# EasyEDA Pro project E33_Panel_2023.9.26.eprj, board PCB1 (continued)
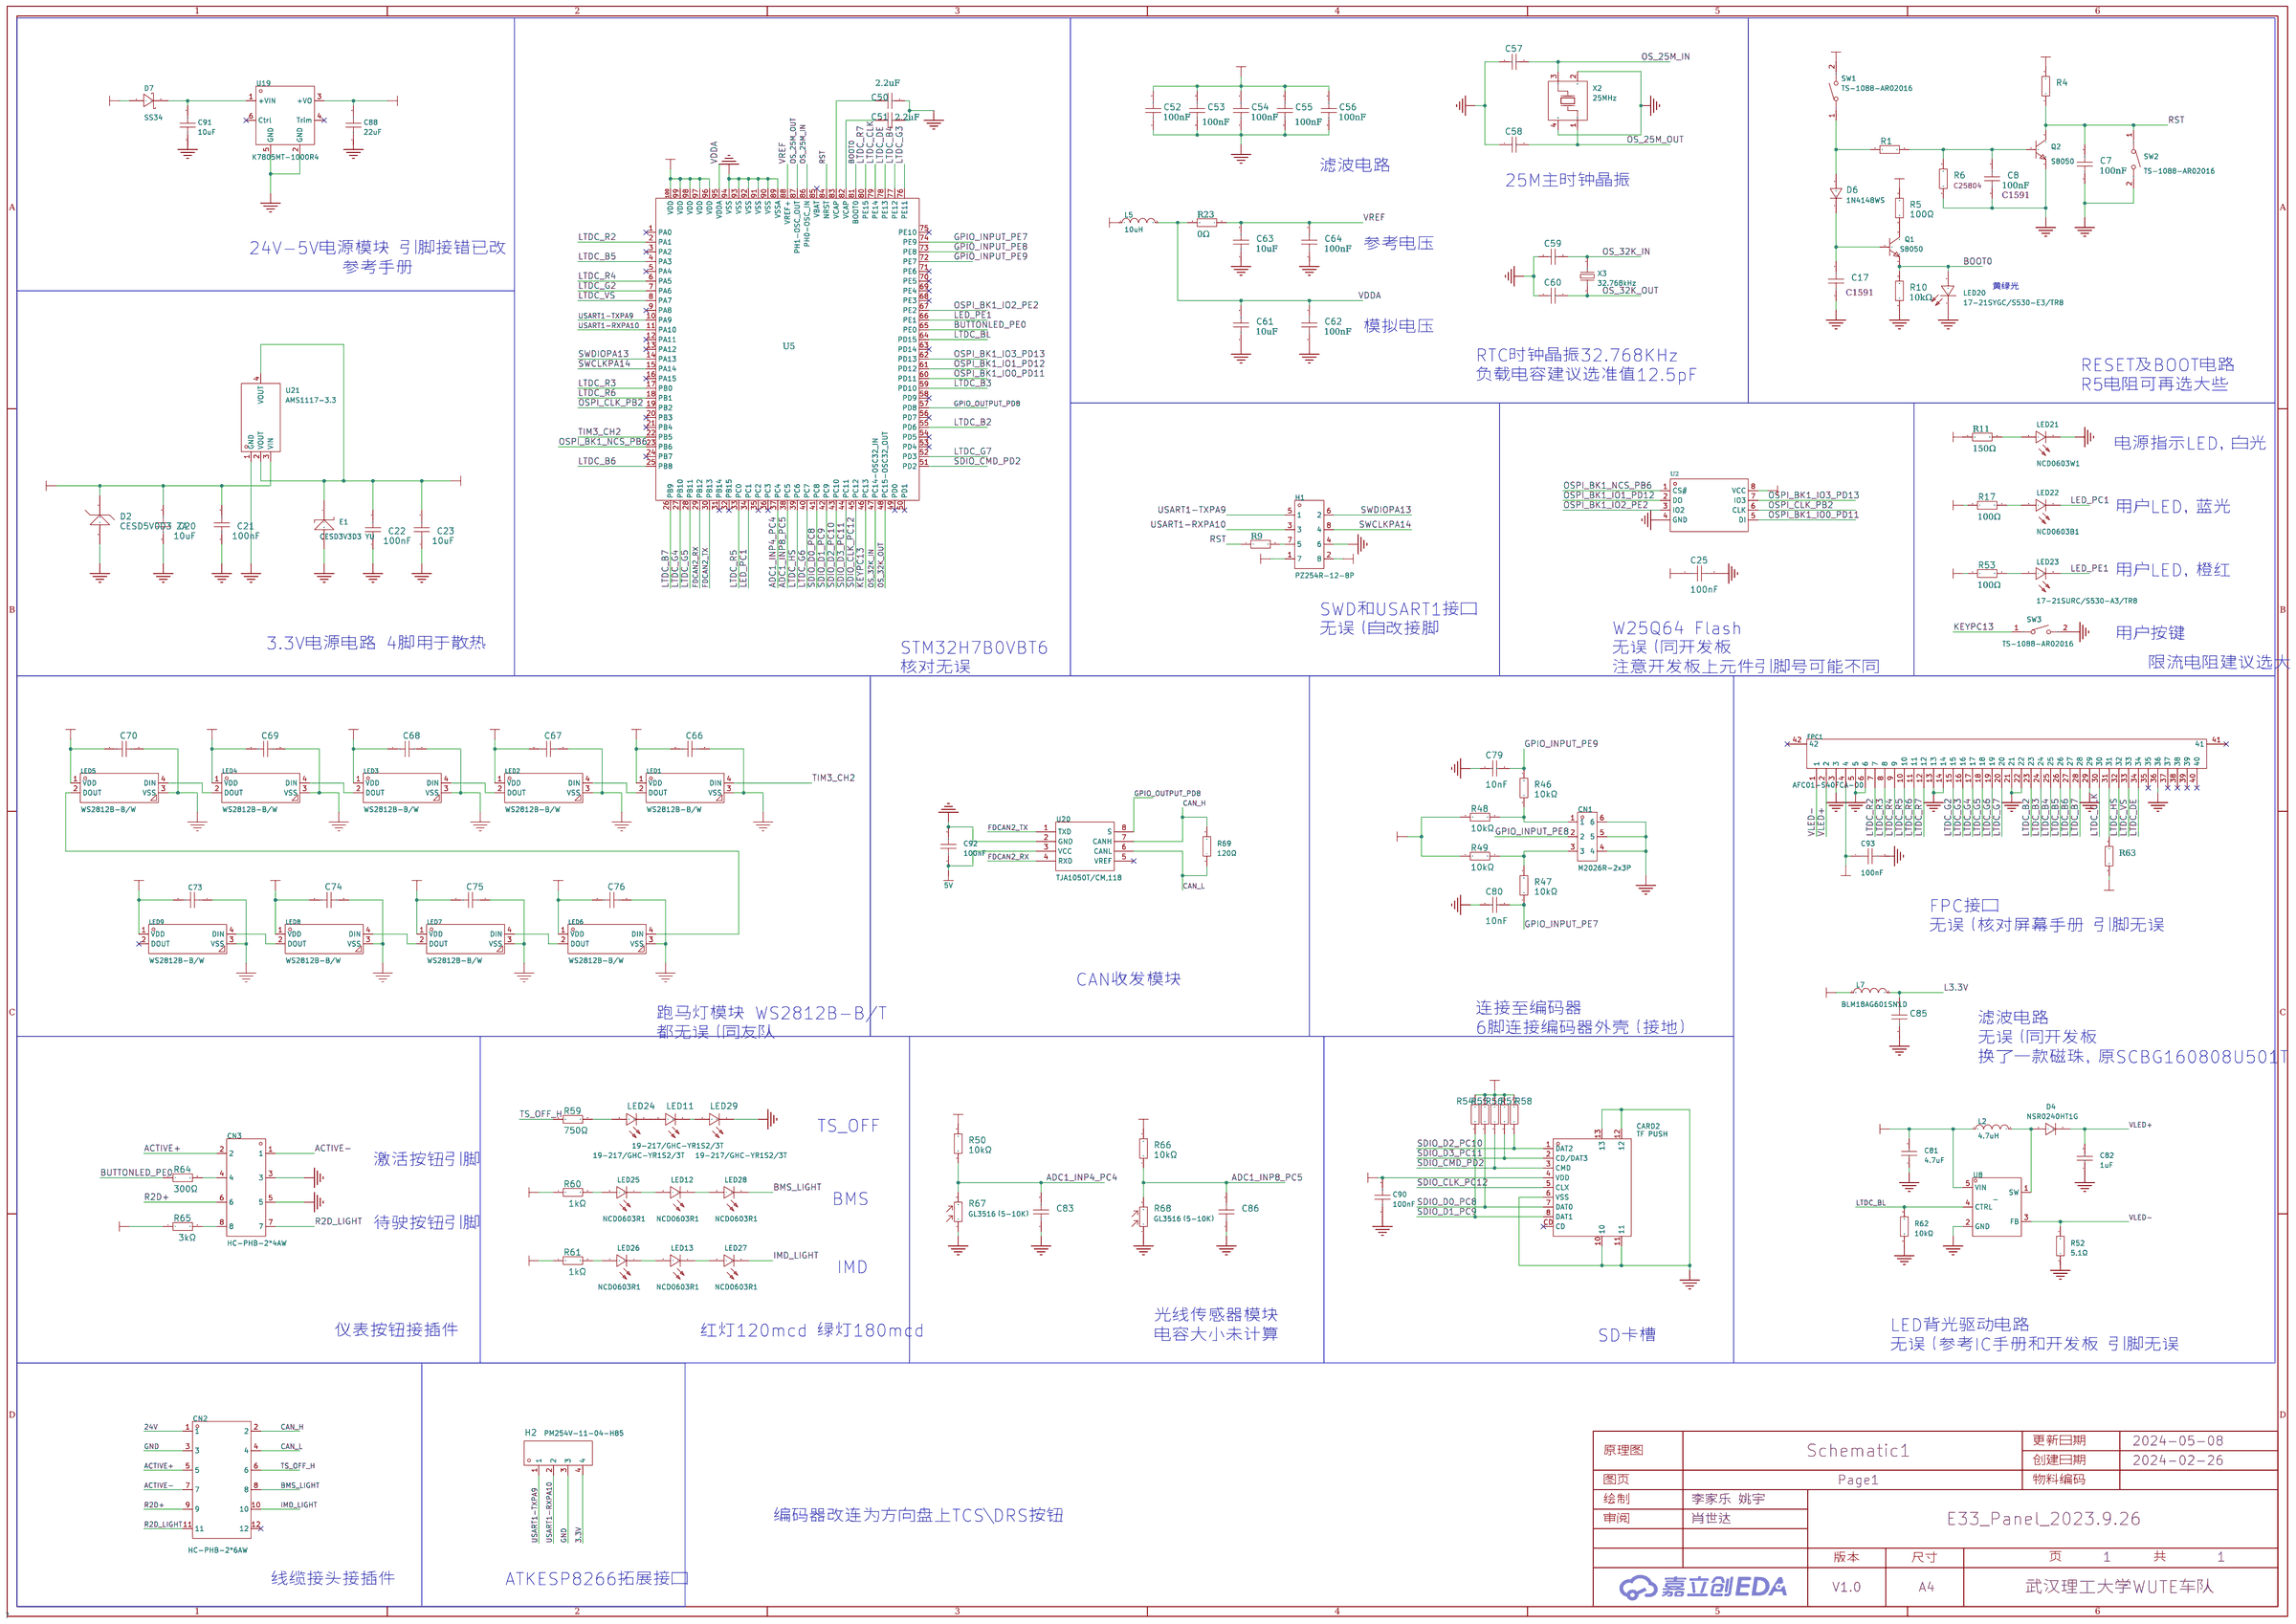
[diagram p0: schematic sheet]
## Nets (continued)
$1N163903: CN1.1 R46.1 R48.2
$1N163918: CN1.3 R47.2 R49.2
$1N186967: Q1.3 R5.1
$1N212327: C91.2 D7.1 U19.1
$1N223537: LED24.2 R59.2
$1N223538: LED11.2 LED24.1
$1N223574: LED25.2 R60.2
$1N223575: LED12.2 LED25.1
$1N223611: LED26.2 R61.2
$1N223612: LED13.2 LED26.1
$1N238063: LED13.1 LED27.2
$1N238102: LED12.1 LED28.2
$1N238151: LED11.1 LED29.2

Pads without a net: CARD2 CD; CN2 12; FPC1 35 37 38 39 40 41 42; LED9 2; U5 2 3 4 5 6 17 18 22 24 28 40 53 54 56 61 67 70 71 77 81 82 85 86 88 89 90 93; U18 5; U19 4 6

## Via types
v1: diameter 1.524, hole 0.762, Top Layer to Bottom Layer, 13 vias
v2: diameter 0.61, hole 0.305, Top Layer to Bottom Layer, 142 vias
v3: diameter 1.219, hole 0.61, Top Layer to Bottom Layer, 4 vias
v4: diameter 1.016, hole 0.508, Top Layer to Bottom Layer, 9 vias

## Routing (per net, layer and track width the routed paths; a pad name or vN(x,y) marks a point on that pad's centre or on a via; arc(x,y) is an arc through that point)
3.3V: length 507.9
  Top Layer w0.203: v2(110.43,74.3) 109.07,75.65 R50.2 ; R55.2 v2(97.72,22.86) ; R57.2 v2(105.6,22.86) ; R56.2 v2(103.06,22.86) ; R66.2 37.91,76.33 v4(39.05,77.47) ; v1(55.56,30.48) 57.9,30.48 R11.1 ; H2.4 87.56,24.64 v2(85.66,22.73) ; v2(64.58,35.43) 64.58,35.94 R5.2 ; v2(69.02,44.96) 70.19,44.96 C54.2 ; U2.8 48.27,28.19 50.88,28.19 50.88,28.21 C25.1 ; v2(95.19,22.86) R54.2 ; 66.25,62.17 65.21,61.14 v3(65.21,61.09) ; U5.11 63.07,51.44 v2(64.07,51.44) 65.21,51.44 65.61,51.83 ; R58.2 v2(108.14,22.86) ; v2(47.18,58.93) 48.74,58.93 R4.2 ; SW1.2 85.91,54.23 v2(84.9,53.21)
  Top Layer w0.254: 57.58,64.12 57.06,64.64 56.58,64.64 54.93,62.99 v2(54.93,61.09) 54.93,59.72 C56.2 54.04,58.83 54.04,55.66 U5.27
  Top Layer w0.305: C90.2 v2(100.39,22.86) 103.53,19.72 CARD2.4 ; 54.97,36.27 54.97,32.94 C52.2 55.56,31.47 v1(55.56,30.48) 55.56,30.35 53.4,28.19 50.88,28.19 ; R53.1 81.97,48.89 80.96,47.88 v2(80.33,47.88) ; 28.45,54.74 36.19,46.99 v4(41.21,46.99) 42.2,46.99 C53.2 43.8,46.94 U5.50 ; v2(66.48,45.09) 66.18,44.78 65.68,44.78 U5.100 ; v2(33.59,64.14) 30.15,64.14 R48.1
  Top Layer w0.508: 72.32,10.93 70.21,8.82 U1.4 U1.2 57.95,16.15 C23.2 C22.2 58.83,20.68 58.83,22.35 E1.1 58.83,22.61 58.83,23.72 v1(59.88,24.77)
  Inner2 w0.203: v2(103.06,22.86) 101.84,21.64 101.84,21.59 103.57,19.86 103.57,18.67 ; v2(64.07,51.44) 66.74,54.1 67.75,54.1 69.17,55.52 70.78,55.52 ; v2(100.39,22.86) 99.12,21.59 ; v2(84.9,53.21) 84.01,52.32 ; 107.03,21.59 107.12,21.59 108.14,22.61 v2(108.14,22.86) ; 93.95,21.59 93.95,21.63 v2(95.19,22.86) ; v2(97.72,22.86) 96.46,21.59 ; v2(105.6,22.86) 104.33,21.59
  Inner2 w0.305: 40.16,48.04 v4(41.21,46.99) ; 40.16,48.04 38.03,50.17 38.03,59.69 v2(33.59,64.14) ; 40.16,48.04 40.19,48.08 40.19,51.94 v2(47.18,58.93) ; v2(80.33,47.88) 74.99,47.88 73.98,48.9 ; 68,42.92 68,43.94 v2(69.02,44.96) ; v2(88.2,52.7) 87.82,52.32 73.98,52.32 ; v2(64.58,35.43) 64.15,35.01 60.09,35.01 ; v2(85.66,22.73) 84.52,21.59 ; v2(66.48,45.09) 67.75,46.36 71.44,46.36 ; 109.54,61.59 110.43,62.48 v2(110.43,74.3) ; v3(65.21,61.09) 62.67,63.63 57.47,63.63 v2(54.93,61.09)
  Inner2 w0.508: 109.54,61.59 93.66,77.47 v4(39.05,77.47) ; v3(65.21,61.09) 73.98,52.32 73.98,48.9 v1(55.56,30.48) 41.21,44.83 v4(41.21,46.99) ; 93.95,21.59 107.03,21.59
  Inner2 w0.762: v1(55.56,30.48) 55.56,29.08 v1(59.88,24.77)
  Inner2 w1.016: v1(59.88,24.77) 63.05,21.59 88.58,21.59 ; 109.54,61.59 109.54,42.55 88.58,21.59 ; 88.58,21.59 93.95,21.59
  Bottom Layer w0.254: v2(88.2,52.7) 88.2,54.02 L7.1
5V: length 355.9
  Top Layer w0.254: C92.2 44.91,38.47 43.37,40.01 43.37,41.54 U18.3
  Top Layer w0.305: v2(41.08,33.15) 44.78,36.84 C92.2
  Top Layer w0.508: v1(25.08,21.46) 25.07,21.46 23.32,23.21 25.85,23.21 U19.3 ; v1(67.25,13.46) 72.19,13.46 H1.2 ; v3(55.65,12.7) U1.3 55.65,15.56 56.45,16.37 56.45,17.6 C21.2 C20.2 57.11,20.68 D2.1 57.11,23.47 v1(55.81,24.77)
  Top Layer w0.762: C88.2 23.32,23.21
  Inner2 w0.305: 45.27,24.77 41.08,28.96 v2(41.08,33.15)
  Inner2 w0.508: 28.9,63.13 28.89,63.15 v4(28.89,74.3) ; v1(67.25,13.46) 65.09,11.3 57.04,11.3 v3(55.65,12.7)
  Inner2 w0.61: v3(104.33,58.93) 90.74,72.52 38.29,72.52 28.9,63.13
  Inner2 w1.016: 28.9,63.13 28.9,38.98 35.88,32 35.88,28.07 39.18,24.77 ; 39.18,24.77 v1(55.81,24.77) ; 39.18,24.77 35.88,21.46 v1(25.08,21.46)
  Bottom Layer w0.305: 105.46,55.95 U8.5 ; L2.1 107.19,53.95 105.79,55.35 C81.2 ; LED9.1 29.5,79.86 C73.2 31.24,77.53 31.94,76.84 34.94,76.84 LED8.1 39.5,81.01 C74.2 41.27,78.68 41.84,78.11 45.37,78.11 LED7.1 49.5,81.88 C75.2 51.31,79.31 52,78.61 55.38,78.61 LED6.1 61.21,81.02 C76.2 61.21,79.82 61.91,79.12 65.77,79.12 LED5.1 71.24,81.11 C70.1 71.24,80.08 72.07,79.25 76.01,79.25 LED4.1 79.5,82.32 C69.1 81.3,79.92 82.1,79.12 86.39,79.12 LED3.1 89.5,81.89 C68.1 91.31,79.44 92.01,78.74 96.84,78.74 LED2.1 99.5,80.96 C67.1 101.22,78.68 101.92,77.98 107.25,77.98 LED1.1 109.5,79.94 C66.1
  Bottom Layer w0.508: v4(28.89,74.3) 28.89,79.62 LED9.1 ; 105.46,55.95 C81.2 105.79,57.47 v3(104.33,58.93)
24V: length 170.9
  Top Layer w0.508: v1(47.94,15.49) 47.92,15.48 CN2.1 ; R65.1 114.83,42 v1(111.19,38.35) ; v1(20,21.98) D7.2
  Inner2 w0.508: v4(7.94,27.69) 7.94,20.19 v4(8.44,19.69) 10.22,17.91 15.93,17.91 v1(20,21.98)
  Inner2 w0.762: v1(111.19,38.35) 111.19,30.35 115.12,26.42 115.12,13.72 107.88,6.48 56.96,6.48 v1(47.94,15.49)
  Inner2 w1.016: v1(20,21.98) 24.2,17.78 45.66,17.78 v1(47.94,15.49)
  Bottom Layer w0.305: 5,20.7 7.43,20.7 v4(8.44,19.69) ; v4(7.94,27.69) 6.92,28.7 5,28.7
GND: length 126.3
  Top Layer w0.203: X2.4 63.28,56.42 62.55,57.15 v2(62.55,58.04) ; LED20.1 v2(70.22,39.06) ; R68.1 v2(41.72,75) ; v2(58.74,51.69) 58.74,52.76 U5.19 ; 60.57,33.09 61.46,33.09 v2(62.04,32.51) ; CN1.6 21.27,58.77 21.27,58.36 CN1.4 ; C59.1 72.83,50.95 72.83,52.45 v2(71.94,53.34) 71.06,54.23 69.56,54.23 69.16,53.84 69.16,53.77 66.27,50.88 63.22,50.88 U5.10 ; v2(63.05,52.45) 63.05,53.05 X2.2 65.44,53.59 67.75,55.91 67.75,57.28 v2(66.74,58.29) 66.12,58.92 64.08,58.92 ; v2(55.43,55.88) 54.98,55.43 54.97,55.43 ; v2(72.32,45.09) 72.3,45.09 C54.1 ; CN1.5 21.27,58.56 ; C8.1 47.31,55.12 v2(46.04,55.12) 46.04,53.85 R6.1 ; 43.25,50.15 42.73,50.67 v2(41.34,50.67) 41.34,49.4 C53.1 ; 65.3,44.4 64.48,45.21 v2(63.94,45.21) ; v2(55.69,37.85) 55.69,37.69 U5.74 ; CN3.6 121.95,43.05 v2(121.98,43.05) ; U5.49 48.1,46.03 v2(48.12,46.03) ; R67.1 v2(101.66,75)
  Top Layer w0.254: 35.88,75.59 v2(34.48,75.59) ; C92.1 v2(47.56,39.5) 48.72,38.34 U2.4
  Top Layer w0.305: v2(105.09,75.69) 106.13,75.69 106.23,75.59 ; C62.1 C61.1 56.48,60.71 v2(56.45,60.71) ; v2(61.02,49.02) 61.37,49.02 U5.10 ; CN3.2 120.97,40.04 v2(120.97,38.73) ; C90.1 v2(96.96,26.29) ; CARD2.6 v2(101.33,18.67)
  Top Layer w0.508: CN2.3 48.88,10.37 v1(49.72,9.53) ; H1.4 74.61,13.6 v1(74.61,15.62) ; v3(62.16,14.99) 60.28,14.99 U1.1 ; v1(34.22,26.54) 34.19,26.51 U19.5 U19.2 ; v1(52.13,20.07) 52.13,19.05 53.53,17.65 C21.1 ; v1(52.13,20.07) 52.13,21.26 53.35,22.48 D2.2 ; v1(52.13,20.07) C20.1 ; C88.1 22.54,25.39 v1(22.54,26.54) 22.54,27.34 23.3,28.1
  Bottom Layer w0.203: FPC1.14 v2(98.35,46.36) 98.85,45.86 FPC1.13 ; FPC1.22 94.35,46.11 v2(94.85,46.61) FPC1.21 ; v2(87.35,46.61) FPC1.36 v2(87.35,44.07) ; FPC1.29 90.87,45.32 v2(90.87,46.61)
  Bottom Layer w0.254: FPC1.5 102.85,44.11 v2(102.55,43.81) 102.35,44.02 FPC1.6 ; FPC1.3 103.85,44.04 v2(104.07,43.81) ; C85.1 90.23,54.14 v2(90.23,52.7)
  Bottom Layer w0.305: 5.78,41.3 v4(7.3,41.3)
  vias: v2(21.27,58.56) v2(51.12,43.18) v2(52.39,49.91) v2(76.01,39.75)
VDDA: length 11.8
  Top Layer w0.254: 56.59,63.13 56.59,63.06 R23.2 58.85,60.8 C61.2 ; C62.2 60.77,58.4 60.77,58.04 59.11,56.39 59.11,54.55 58.58,54.01
  Top Layer w0.305: C61.2 C62.2
ACTIVE+: length 120.2
  Top Layer w0.305: CN2.11 48.51,1.78 114.11,1.78 118.93,6.6 118.93,31.5 124.01,36.58 124.01,44.85 121.62,47.24 120.14,47.24 CN3.7
ACTIVE-: length 115.6
  Top Layer w0.305: CN2.9 47.92,4.33 49.97,2.29 113.85,2.29 118.43,6.86 118.43,31.75 123.51,36.83 123.51,43.5 CN3.8
ADC1_INP4_PC4: length 71.8
  Top Layer w0.203: v2(102.42,70.74) 103.06,71.37 103.06,74.36 R67.2 104.89,75 105.7,74.19 C83.2 108.22,74.19 R50.1 ; v2(52.26,54.48) 52.26,53.9 U5.32
  Bottom Layer w0.203: v2(102.42,70.74) 62.04,70.74 52.26,60.96 v2(52.26,54.48)
ADC1_INP8_PC5: length 35.6
  Top Layer w0.203: v2(44.89,70.74) 44.89,73.81 R68.2 43.69,75 41.97,73.28 38.78,73.28 R66.1 37.86,74.19 C86.2 ; U5.33 51.86,53.59 v2(51.24,53.59)
  Bottom Layer w0.203: v2(44.89,70.74) 44.89,58.8 50.1,53.59 v2(51.24,53.59)
BMS_LIGHT: length 52.5
  Top Layer w0.305: CN2.8 42.87,6.37 v4(42.86,6.36)
  Bottom Layer w0.305: 5.78,33.3 9.71,29.37 9.71,27.31 30.66,6.36 v4(42.86,6.36)
BOOT0: length 7.5
  Top Layer w0.203: Q1.2 67.15,39.01 R10.2 67.13,41.8 67.48,41.8 ; 63.53,42.63 65.75,40.41
BUTTONLED_PE0: length 55.9
  Top Layer w0.203: U5.97 65.23,43.05 66.17,43.05 69.47,46.36 74.85,46.36 80.82,40.39 107.38,40.39 111.06,44.07 R64.1
CAN_H: length 29.6
  Top Layer w0.203: CN2.2 44.66,12.37 41.24,15.79 41.24,26.01 39.33,27.91 39.33,35.54 R69.2 41.27,37.48 U18.7
CAN_L: length 31.8
  Top Layer w0.203: CN2.4 45.92,10.53 40.83,15.62 40.83,25.84 38.92,27.75 38.92,37.24 39.07,37.24 U18.6
FDCAN2_RX: length 3.8
  Top Layer w0.203: U18.4 44.23,44.2 45.93,44.2 U5.51
FDCAN2_TX: length 4.2
  Top Layer w0.203: U18.1 46.29,40.87 46.29,43.85 U5.52
GPIO_INPUT_PE7: length 26.3
  Top Layer w0.203: 50.38,50.83 49.77,51.44 48.7,51.44 48.7,51.44 46.82,49.56 45.38,49.56 37.78,57.15 31.07,57.15 30.8,56.88 30.53,57.15 R47.1
GPIO_INPUT_PE8: length 30.3
  Top Layer w0.203: CN1.2 36.88,58.56 45.53,49.91 46.67,49.91 48.58,51.82 50.1,51.82 U5.38
GPIO_INPUT_PE9: length 27.9
  Top Layer w0.203: U5.37 50.43,52.2 48.45,52.2 46.54,50.29 45.66,50.29 36,59.94 31.03,59.94 30.8,60.18 30.51,59.89 R46.2
GPIO_OUTPUT_PD8: length 17.5
  Top Layer w0.203: U5.55 48.45,43.88 48.45,44.45 47.18,45.72 43.35,45.72 41.46,43.84 41.46,39.75 42.73,38.48 42.73,37.31 U18.8
IMD_LIGHT: length 48.8
  Top Layer w0.305: CN2.10 45.91,4.35 v4(42.86,4.35)
  Bottom Layer w0.305: 5.78,25.3 10.2,25.3 31.14,4.35 v4(42.86,4.35)
KEYPC13: length 29.4
  Top Layer w0.203: 63.53,49.06 64.04,49.57 64.92,49.57 67.4,47.09 71.66,47.09 76.01,51.44 76.01,59.18 77.94,61.11 SW3.1
L3.3V: length 33.1
  Inner2 w0.254: v2(103.31,46.99) 94.68,55.63 v2(93.66,55.63)
  Bottom Layer w0.254: C85.2 90.28,55.59 R63.1 92.17,55.63 v2(93.66,55.63) ; v2(103.31,46.99) 103.35,46.95 FPC1.4 103.35,32.54 C93.1 ; L7.2 90.23,55.54
LED_PC1: length 14.2
  Top Layer w0.203: U5.16 60.86,52.76 60.86,53.51 60.13,54.23 60.13,56.13 61.78,57.78 61.78,58.67 63.31,60.2 67.12,60.2 67.57,60.65
LED_PE1: length 21.7
  Top Layer w0.203: LED23.2 83.39,46.74 69.28,46.74 66.07,43.53 65.45,43.53 64.94,44.04
LTDC_B2: length 37.5
  Top Layer w0.203: U5.87 61.91,39.3 v2(61.91,39.24)
  Bottom Layer w0.203: v2(61.91,39.24) 62.83,38.33 88.69,38.33 93.85,43.49 FPC1.23
LTDC_B3: length 48.5
  Top Layer w0.203: v2(55.69,44.58) 55,43.89 49.87,43.89 U5.57 ; v2(86.29,42.42) 91.88,42.42 v2(93.15,43.69)
  Bottom Layer w0.203: FPC1.24 93.35,43.89 v2(93.15,43.69) ; v2(55.69,44.58) 57.46,44.58 58.12,43.92 84.8,43.92 v2(86.29,42.42)
LTDC_B4: length 48.4
  Top Layer w0.203: v2(52.89,48.26) 50.83,48.26 U5.42
  Bottom Layer w0.203: FPC1.25 92.85,46.91 91.25,48.51 78.55,48.51 76.01,45.97 58.86,45.97 56.58,48.26 v2(52.89,48.26)
LTDC_B5: length 78.5
  Top Layer w0.254: 57.16,55.43 56.7,55.89 v2(56.7,56.26)
  Inner1 w0.203: v2(56.7,56.26) 56.7,58.14 64.94,66.37 88.25,66.37 98.23,56.39 98.23,51.56 102.17,47.62 102.17,44.38 100.2,42.42 93.41,42.42 92.39,43.43 v2(92.39,44.07)
  Bottom Layer w0.203: v2(92.39,44.07) 92.39,45.26 FPC1.26
LTDC_B6: length 32.4
  Top Layer w0.203: U5.95 64.83,42.04 v2(64.96,42.04)
  Bottom Layer w0.203: FPC1.27 91.84,45.29 91.84,44.15 87.31,39.62 81.79,39.62 79.68,41.73 65.26,41.73 v2(64.96,42.04)
LTDC_B7: length 31.4
  Top Layer w0.203: v2(65.97,42.29) 65.59,42.29 65.26,42.63 64.95,42.63 U5.96
  Bottom Layer w0.203: FPC1.28 91.35,44.17 87.16,39.98 81.94,39.98 79.63,42.29 v2(65.97,42.29)
LTDC_BL: length 70.2
  Top Layer w0.203: v2(52.26,42.8) 52.26,42.74 50.38,40.86
  Inner1 w0.203: v2(52.26,42.8) 55.56,46.1 55.56,49.44 59.04,52.92 59.04,57.45 65.82,64.24 86.96,64.24 v2(91.25,59.94)
  Bottom Layer w0.203: U8.4 101.09,55.95 R62.2 98.35,58.04 93.15,58.04 v2(91.25,59.94)
LTDC_CLK: length 45.7
  Top Layer w0.203: v2(90.1,44.07) 89.09,43.05 86.55,43.05 v2(85.91,43.69) ; U5.44 50.94,46.74 v2(53.53,46.74)
  Bottom Layer w0.203: v2(85.91,43.69) 85.33,44.27 58.41,44.27 57.47,45.21 55.05,45.21 v2(53.53,46.74) ; FPC1.30 90.35,44.31 v2(90.1,44.07)
LTDC_DE: length 46
  Top Layer w0.203: U5.43 50.88,47.5 v2(51.62,47.5)
  Bottom Layer w0.203: v2(51.62,47.5) 55.92,43.21 79.72,43.21 82.16,40.77 85.86,40.77 88.35,43.25 FPC1.34
LTDC_G2: length 77.1
  Top Layer w0.203: U5.30 55.12,52.45 v2(55.56,52.45)
  Inner1 w0.203: v2(98.61,43.05) 98.87,42.8 100.01,42.8 101.79,44.58 101.79,47.5 97.85,51.44 97.85,56.27 88.1,66.01 65.09,66.01 57.26,58.19 57.26,53.72 55.99,52.45 v2(55.56,52.45)
  Bottom Layer w0.203: FPC1.15 97.85,43.82 v2(98.61,43.05)
LTDC_G3: length 52.7
  Top Layer w0.203: v2(51.62,49.02) 50.77,49.02 U5.41
  Bottom Layer w0.203: 97.34,45.6 97.34,47.24 95.67,48.92 78.32,48.92 75.73,46.33 59.14,46.33 56.45,49.02 v2(51.62,49.02)
LTDC_G4: length 77.3
  Top Layer w0.203: U5.46 51.05,45.21 v2(52.77,45.21)
  Inner1 w0.203: v2(52.77,45.21) 53.66,45.21 54.85,46.4 54.85,49.8 58.33,53.28 58.33,57.75 65.53,64.95 87.66,64.95 95.82,56.79 95.82,47.88 v2(96.46,47.24)
  Bottom Layer w0.203: FPC1.17 96.85,46.85 v2(96.46,47.24)
LTDC_G5: length 77.3
  Top Layer w0.203: U5.47 51.1,44.45 v2(51.62,44.45)
  Inner1 w0.203: v2(51.62,44.45) 53.4,44.45 55.21,46.25 55.21,49.64 58.69,53.12 58.69,57.6 65.68,64.59 87.51,64.59 95.46,56.65 95.46,47.35 v2(95.69,47.12)
  Bottom Layer w0.203: v2(95.69,47.12) 96.35,46.46 FPC1.18
LTDC_G6: length 50.1
  Top Layer w0.203: v2(95.82,43.69) 93.91,41.78 v2(85.53,41.78) ; v2(56.32,43.94) 54.04,41.66 52.59,41.66 U5.64
  Bottom Layer w0.203: v2(56.32,43.94) 57.59,43.94 57.97,43.56 79.87,43.56 82.26,41.16 84.91,41.16 v2(85.53,41.78) ; v2(95.82,43.69) 95.85,43.72 FPC1.19
LTDC_G7: length 39.3
  Top Layer w0.203: U5.84 61.11,37.97 v2(61.4,37.97)
  Bottom Layer w0.203: v2(61.4,37.97) 88.84,37.97 95.35,44.49 FPC1.20
LTDC_HS: length 43.3
  Top Layer w0.203: v2(53.15,42.8) 50.86,40.51 U5.63
  Bottom Layer w0.203: v2(53.15,42.8) 53.2,42.85 79.57,42.85 82.09,40.34 85.93,40.34 89.35,43.75 89.35,44.98
LTDC_R2: length 61.8
  Top Layer w0.203: v2(56.07,58.17) 58.38,55.85 58.38,55.23 U5.23
  Bottom Layer w0.203: v2(56.07,58.17) 56.07,58.93 60.64,63.5 68.64,63.5 81.72,50.42 98.74,50.42 101.85,47.31 FPC1.7
LTDC_R3: length 70.7
  Top Layer w0.203: U5.34 53.31,51.44 v2(53.78,51.44)
  Inner1 w0.203: v2(53.78,51.44) 55.48,51.44 57.62,53.57 57.62,58.04 65.23,65.66 87.96,65.66 97.47,56.14 97.47,50.8 v2(101.03,47.24)
  Bottom Layer w0.203: FPC1.8 101.35,46.92 v2(101.03,47.24)
LTDC_R4: length 54.3
  Top Layer w0.203: U5.29 55.07,53.21 v2(55.31,53.21)
  Bottom Layer w0.203: v2(55.31,53.21) 55.59,53.21 57.29,51.52 57.29,50.44 60.33,47.4 75.02,47.4 77.68,50.06 97.42,50.06 100.85,46.63 FPC1.9
LTDC_R5: length 51
  Top Layer w0.203: v2(58.35,48.51) 58.35,50.04 59.37,51.05 59.86,51.05 U5.15
  Bottom Layer w0.203: FPC1.10 100.35,46.63 97.27,49.71 77.84,49.71 75.17,47.04 59.83,47.04 v2(58.35,48.51)
LTDC_R6: length 53.9
  Top Layer w0.203: 51.79,52.25 53.36,50.67 v2(53.78,50.67)
  Bottom Layer w0.203: v2(53.78,50.67) 55.41,50.67 59.39,46.69 75.45,46.69 78.09,49.33 97.15,49.33 99.85,46.62 FPC1.11
LTDC_R7: length 78.1
  Top Layer w0.203: U5.45 50.99,45.97 v2(51.62,45.97)
  Inner1 w0.203: v2(98.36,47.24) 96.17,49.43 96.17,56.94 87.81,65.3 65.38,65.3 57.97,57.9 57.97,53.43 54.49,49.95 54.49,46.55 53.92,45.97 v2(51.62,45.97)
  Bottom Layer w0.203: FPC1.12 99.35,46.25 v2(98.36,47.24)
LTDC_VS: length 42.4
  Top Layer w0.203: U5.31 56.19,50.67 v2(57.85,50.67)
  Inner1 w0.254: v2(78.55,50.67) 85.03,50.67 v2(88.2,47.5)
  Bottom Layer w0.203: v2(88.2,47.5) 88.85,46.85 FPC1.33 ; v2(78.55,50.67) 77.66,50.67 74.74,47.75 60.77,47.75 v2(57.85,50.67)
OS_25M_IN: length 8.7
  Top Layer w0.203: 61.76,50.83 62.39,51.46 62.39,53.95 63.21,54.77 64.77,54.77 66.5,56.5 66.5,56.63
OS_25M_OUT: length 9.2
  Top Layer w0.203: U5.13 62.04,51.82 X2.1 63.59,55.15 65.07,56.63 65.07,57.92
OS_32K_IN: length 10.2
  Top Layer w0.203: C59.2 71.45,51.11 X3.2 67.58,49.06 66.61,50.04 63.8,50.04 U5.8
OS_32K_OUT: length 8.6
  Top Layer w0.203: 70.15,52.84 69.64,52.84 67.28,50.48 63.53,50.48 U5.9
OSPI_BK1_IO0_PD11: length 11.7
  Top Layer w0.203: v2(47.43,40.77) 47.45,40.77 U5.58 ; U2.5 43.74,32.75 v2(45.15,34.16)
  Inner1 w0.203: v2(45.15,34.16) 46.67,35.69 46.67,40.01 v2(47.43,40.77)
OSPI_BK1_IO1_PD12: length 7.7
  Top Layer w0.254: U2.2 51.12,36.57 51.12,37.53 48.37,40.27 48.37,40.95 49.32,41.89 U5.59
OSPI_BK1_IO2_PE2: length 26.6
  Top Layer w0.203: v2(47.56,35.94) 48.69,35.94 U2.3 ; U5.1 64.81,46.1 63.69,46.1 56.83,39.24 v2(55.94,39.24)
  Inner1 w0.203: v2(47.56,35.94) 47.31,36.2 47.31,37.85 48.7,39.24 v2(55.94,39.24)
OSPI_BK1_IO3_PD13: length 12.3
  Top Layer w0.203: U2.7 45.5,30.96 v2(46.92,32.39)
  Top Layer w0.254: v2(48.96,40.51) 48.96,40.86 U5.60
  Bottom Layer w0.203: v2(48.96,40.51) 48.96,34.42 v2(46.92,32.39)
OSPI_BK1_NCS_PB6: length 14.8
  Top Layer w0.203: v2(52.51,36.2) 51.41,35.09 U2.1 ; U5.92 62.2,42.55 61.02,42.55 v2(59.5,41.02)
  Inner1 w0.203: v2(52.51,36.2) 54.88,38.56 57.03,38.56 v2(59.5,41.02)
OSPI_CLK_PB2: length 29.5
  Top Layer w0.203: v2(56.58,42.04) 57.59,43.05 57.59,45.74 U5.36 ; U2.6 46.03,33.27 v2(48.7,33.27)
  Bottom Layer w0.203: v2(56.58,42.04) 54.16,39.62 54.16,38.73 v2(48.7,33.27)
R2D+: length 106.6
  Top Layer w0.305: CN2.5 47.92,8.27 52.89,3.3 113.35,3.3 117.41,7.37 117.41,32.26 118.95,33.8 CN3.1
R2D_LIGHT: length 111.2
  Top Layer w0.305: CN3.4 123,40.01 123,37.08 117.92,32 117.92,7.11 113.6,2.79 51.5,2.79 CN2.7
RST: length 74.3
  Top Layer w0.203: v2(59.75,50.29) 59.81,50.29 60.26,50.75 ; 60.26,50.75 U5.14 ; 60.26,50.75 v2(60.26,49.78) ; v2(53.4,56.64) 53.4,57.28 52.88,57.8 52.22,57.13 Q2.3 50.48,57.88 50.48,59.53 R4.1 48.87,61.13 42.99,61.13
  Top Layer w0.305: v2(82.99,16) 82.99,13.33 R9.1
  Inner1 w0.203: v2(82.99,16) 81.09,17.91 77.43,17.91 60.26,35.08 v2(60.26,49.78)
  Bottom Layer w0.203: v2(59.75,50.29) 59.24,50.29 53.4,56.13 v2(53.4,56.64)
SDIO_CLK_PC12: length 55.1
  Top Layer w0.203: 58.58,37.68 59.3,36.96 59.87,36.96 67.06,29.77 92.09,29.77 102.43,19.42 CARD2.5
SDIO_CMD_PD2: length 58.6
  Top Layer w0.203: 99.97,24.68 100,24.68 R56.1 ; 99.97,24.68 94.42,30.23 67.12,30.23 60.24,37.11 60.24,38.14 U5.83 ; 99.97,24.68 104.63,20.02 CARD2.3
SDIO_D0_PC8: length 62.6
  Top Layer w0.203: CARD2.7 100.23,19.08 94.64,24.67 ; 94.64,24.67 94.66,24.67 R55.1 ; 94.64,24.67 91.38,27.94 v2(76.13,27.94) ; U5.65 52.53,40.89 v2(57.09,40.89)
  Bottom Layer w0.203: v2(76.13,27.94) 70.55,27.94 57.59,40.89 v2(57.09,40.89)
SDIO_D1_PC9: length 59.9
  Top Layer w0.203: 92.15,24.62 99.13,17.64 CARD2.8 ; 92.15,24.62 89.47,27.31 v2(76.77,27.31) ; 92.15,24.62 92.75,25.22 R54.1 ; 51.79,39.45 52.6,40.26 v2(56.45,40.26)
  Bottom Layer w0.203: v2(76.77,27.31) 70.68,27.31 57.72,40.26 v2(56.45,40.26)
SDIO_D2_PC10: length 62.9
  Top Layer w0.203: R58.1 105.08,24.68 105.05,24.68 ; 105.05,24.68 101.15,28.58 v2(100.01,28.58) ; 105.05,24.68 106.83,22.9 CARD2.1 ; U5.78 58.65,36.2 59.62,36.2 67.25,28.58 v2(75.5,28.58)
  Bottom Layer w0.203: v2(100.01,28.58) v2(75.5,28.58)
SDIO_D3_PC11: length 60.7
  Top Layer w0.203: 102.52,24.67 102.53,24.67 R57.1 ; 102.52,24.67 v2(97.98,29.21) ; 102.52,24.67 105.73,21.46 CARD2.2 ; U5.79 58.98,36.58 59.75,36.58 67.11,29.21 v2(74.87,29.21)
  Bottom Layer w0.203: v2(97.98,29.21) v2(74.87,29.21)
SWCLKPA14: length 32.4
  Top Layer w0.203: v2(58.1,35.31) 58.1,35.33 57.16,36.27 ; v2(77.28,16) 77.28,16 H1.8
  Inner1 w0.203: v2(58.1,35.31) 58.1,34.76 76.86,16 v2(77.28,16)
SWDIOPA13: length 36.2
  Top Layer w0.203: v2(53.15,35.69) 53.15,36.56 U5.72 ; v2(77.02,15.24) 77.02,13.72 H1.6
  Inner1 w0.203: v2(77.02,15.24) 77.02,15.34 57.69,34.67 54.16,34.67 v2(53.15,35.69)
TIM3_CH2: length 96.1
  Top Layer w0.203: U5.91 63.52,40.51 v2(63.56,40.51)
  Inner1 w0.203: v2(63.56,40.51) 68.64,35.43 103.19,35.43 112.58,44.83 112.58,57.78 117.41,62.61 117.41,78.87 v2(116.9,79.38)
  Bottom Layer w0.203: v2(116.9,79.38) 116.05,80.22 LED1.4
TS_OFF_H: length 55.5
  Top Layer w0.305: CN2.6 45.91,8.38 v4(42.86,8.38)
  Bottom Layer w0.305: 5,36.7 6.65,36.7 11.24,32.12 11.24,27.29 30.15,8.38 v4(42.86,8.38)
USART1-RXPA10: length 66.8
  Top Layer w0.203: 74.87,10.93 75.63,10.17 v2(75.63,8.64) ; v2(68.13,19.69) 68.27,19.69 68.52,19.94 77.91,19.94 82.49,24.51 82.49,24.68 ; v2(52,37.47) 52.36,37.82 52.36,37.9 U5.69
  Inner1 w0.203: v2(52,37.47) 51.75,37.47 50.23,35.94 50.23,33.02 53.91,29.34 58.48,29.34 68.13,19.69 v2(68.13,19.69) 68.13,19.3 69.51,17.93 69.51,10.05 71.56,8 75.37,8 75.63,8.25 v2(75.63,8.64)
USART1-TXPA9: length 68.5
  Top Layer w0.203: 77.41,10.93 76.52,10.04 v2(76.52,8.64) ; U5.68 51.98,38.23 51.5,38.23 v2(51.37,38.1) ; H2.1 79.94,22.47 77.77,20.29 67.6,20.29 67.25,19.94 v2(67.25,19.69)
  Inner1 w0.203: v2(51.37,38.1) 51.37,37.59 49.87,36.09 49.87,32.87 53.78,28.96 58.35,28.96 67.25,20.07 v2(67.25,19.69) 69.15,17.78 69.15,9.91 71.44,7.62 75.5,7.62 v2(76.52,8.64)
VLED+: length 7.6
  Bottom Layer w0.254: C82.2 102.49,49.59 104.33,47.75 104.33,45.32 FPC1.2
  Bottom Layer w0.305: D4.1 102.49,51.41 C82.2
VLED-: length 13.4
  Top Layer w0.254: v2(105.47,47.24) 104.2,48.51 v2(102.68,48.51)
  Bottom Layer w0.254: v2(102.68,48.51) 102.42,48.51 100.76,50.17 R52.2
  Bottom Layer w0.305: U8.3 102.42,53.6 R52.2 ; v2(105.47,47.24) 105.47,45.92 FPC1.1
VREF: length 10.9
  Top Layer w0.254: 61.67,60.06 61.67,59.2 61.28,58.8 61.28,57.91 59.62,56.26 59.62,54.35 U5.20 ; C63.2 61.67,60.47 C64.2 ; 60.04,62.09 59.25,62.89 R23.1
$1N3072: length 55.2
  Top Layer w0.203: 67.25,66.93 81.66,66.93 85.91,62.67 SW1.1 ; 67.25,66.93 v2(62.29,66.93) ; 67.25,66.93 D6.2 ; v2(44.51,54.23) 44.51,52.96 R1.1
  Inner1 w0.203: v2(62.29,66.93) 56.07,66.93 44.51,55.37 v2(44.51,54.23)
$1N3073: length 5.9
  Top Layer w0.203: 48.81,56.06 48.81,53.85 C8.2 48.69,53.66 R6.2 46.31,51.28 R1.2
$1N3080: length 36.6
  Top Layer w0.203: D6.1 74.87,59.31 v2(74.87,55.37) ; Q1.1 69.99,37.67 71.06,38.73 71.06,40.01 ; v2(73.09,40.89) 72.2,40.01 71.06,40.01 ; C17.2 68.51,43.15 68.51,42.55 71.06,40.01
  Inner1 w0.203: v2(73.09,40.89) 74.87,42.67 v2(74.87,55.37)
$1N3093: length 1.8
  Top Layer w0.203: R11.2 58.2,32.98 59.44,34.22
$1N3094: length 2
  Top Layer w0.203: 68.7,61.78 68.7,61.85 R17.2
$1N3180: length 3.4
  Top Layer w0.203: U5.73 53.76,36.46 53.76,34.64 C51.2
$1N3181: length 3.6
  Top Layer w0.203: U5.48 46.2,48.64 44.77,48.64 44.25,49.16
$1N3236: length 9.7
  Inner2 w0.254: v2(92.14,52.7) 92.14,48.9 v2(89.85,46.61)
  Bottom Layer w0.203: v2(89.85,46.61) 89.85,45.3
  Bottom Layer w0.254: R63.2 v2(92.14,52.7)
$1N3252: length 6.3
  Bottom Layer w0.203: LED4.2 76.31,82.85 LED5.4
$1N3253: length 6.2
  Bottom Layer w0.203: LED4.4 86.7,82.74 89.5,85.53
$1N3254: length 6
  Bottom Layer w0.203: LED3.4 97.04,82.23 LED2.2
$1N3255: length 5.9
  Bottom Layer w0.203: 109.5,83.52 107.37,81.4 LED2.4
$1N3256: length 6.6
  Bottom Layer w0.203: LED6.2 55.7,82.23 LED7.4
$1N3257: length 6.7
  Bottom Layer w0.203: 49.5,85.53 45.36,81.4 LED8.4
$1N3330: length 2.8
  Top Layer w0.203: LED23.1 84.24,50.41 R53.2
$1N3457: length 6.9
  Bottom Layer w0.203: LED9.4 35.03,80.22 LED8.2
$1N3464: length 6.4
  Bottom Layer w0.203: LED6.4 66.09,82.74 69.5,86.15
$1N107193: length 2.6
  Top Layer w0.203: CN3.5 118.93,44.07 R64.2
$1N107203: length 2.6
  Top Layer w0.305: R65.2 118.93,42.04 CN3.3
$1N160553: length 3.3
  Top Layer w0.305: 83.01,11.56 82.38,10.93 79.94,10.93
$1N161135: length 4.1
  Bottom Layer w0.305: L2.2 104.02,53.59 U8.1 103.87,52.38 D4.2
$1N163903: length 4.8
  Top Layer w0.203: CN1.1 25.73,59.89 R46.1 R48.2
$1N163918: length 4.6
  Top Layer w0.203: 27.05,54.74 26.99,54.79 R47.2 25.65,57.15 CN1.3
$1N186967: length 4
  Top Layer w0.203: R5.1 63.39,38.1 64.32,38.1 65.83,36.59 Q1.3
$1N212327: length 7.4
  Top Layer w0.508: U19.1 25.86,29.8 21.09,29.8 D7.1
$1N223537: length 3.3
  Bottom Layer w0.305: 2.22,39.7 2.22,37.49 3,36.7
$1N223538: length 1.8
  Bottom Layer w0.305: 2.22,41.3 LED11.2
$1N223574: length 3.3
  Bottom Layer w0.305: 3,28.7 2.22,29.48 2.22,31.7
$1N223575: length 1.8
  Bottom Layer w0.305: 4,33.3 2.22,33.3
$1N223611: length 3.3
  Bottom Layer w0.305: 2.22,23.7 2.22,21.48 3,20.7
$1N223612: length 1.8
  Bottom Layer w0.305: LED13.2 2.22,25.3
$1N238063: length 1.8
  Bottom Layer w0.305: 5.77,23.7 LED13.1
$1N238102: length 1.8
  Bottom Layer w0.305: 4,31.7 5.77,31.7
$1N238151: length 1.8
  Bottom Layer w0.305: LED11.1 5.77,39.7

## Copper pours and planes (outline as drawn; the poured copper is in the pictures)
GND on Top Layer: -3.75,92.71 148.14,92.71 148.14,-3.43 -3.75,-3.43
GND on Bottom Layer: -12.89,98.04 155,98.04 155,-9.4 -12.89,-9.4
GND on Inner1: -21.78,104.14 166.56,104.14 166.56,-16.13 -21.78,-16.13

Small or netless copper shapes (teardrops, artwork), in the pictures only: 449 on Top Layer, 192 on Bottom Layer, 42 on Inner1, 71 on Inner2

## Text on the board
Bottom Silkscreen Layer: PANEL
Top Silkscreen Layer: CAN_H     24V / CAN_L     GND / TSOFF     R2D+ / BMSLED R2DLED / IMDLED  ACTIVE- / -/        ACTIVE+ | 5V   GND DIO CLK / 3V3   RX   TX  RST | ATKESP8266 / 拓展接口 | 编码器接口 | Schematic：姚宇 李家乐 / PCB Layout：李家乐 / Review：肖世达 | 按钮接口 | E33_PANEL
